# EasyEDA Pro project ProPrj_Avaota A1 八核 AIoT 开发板_2024-05-03.epro, board PCB1 (continued)
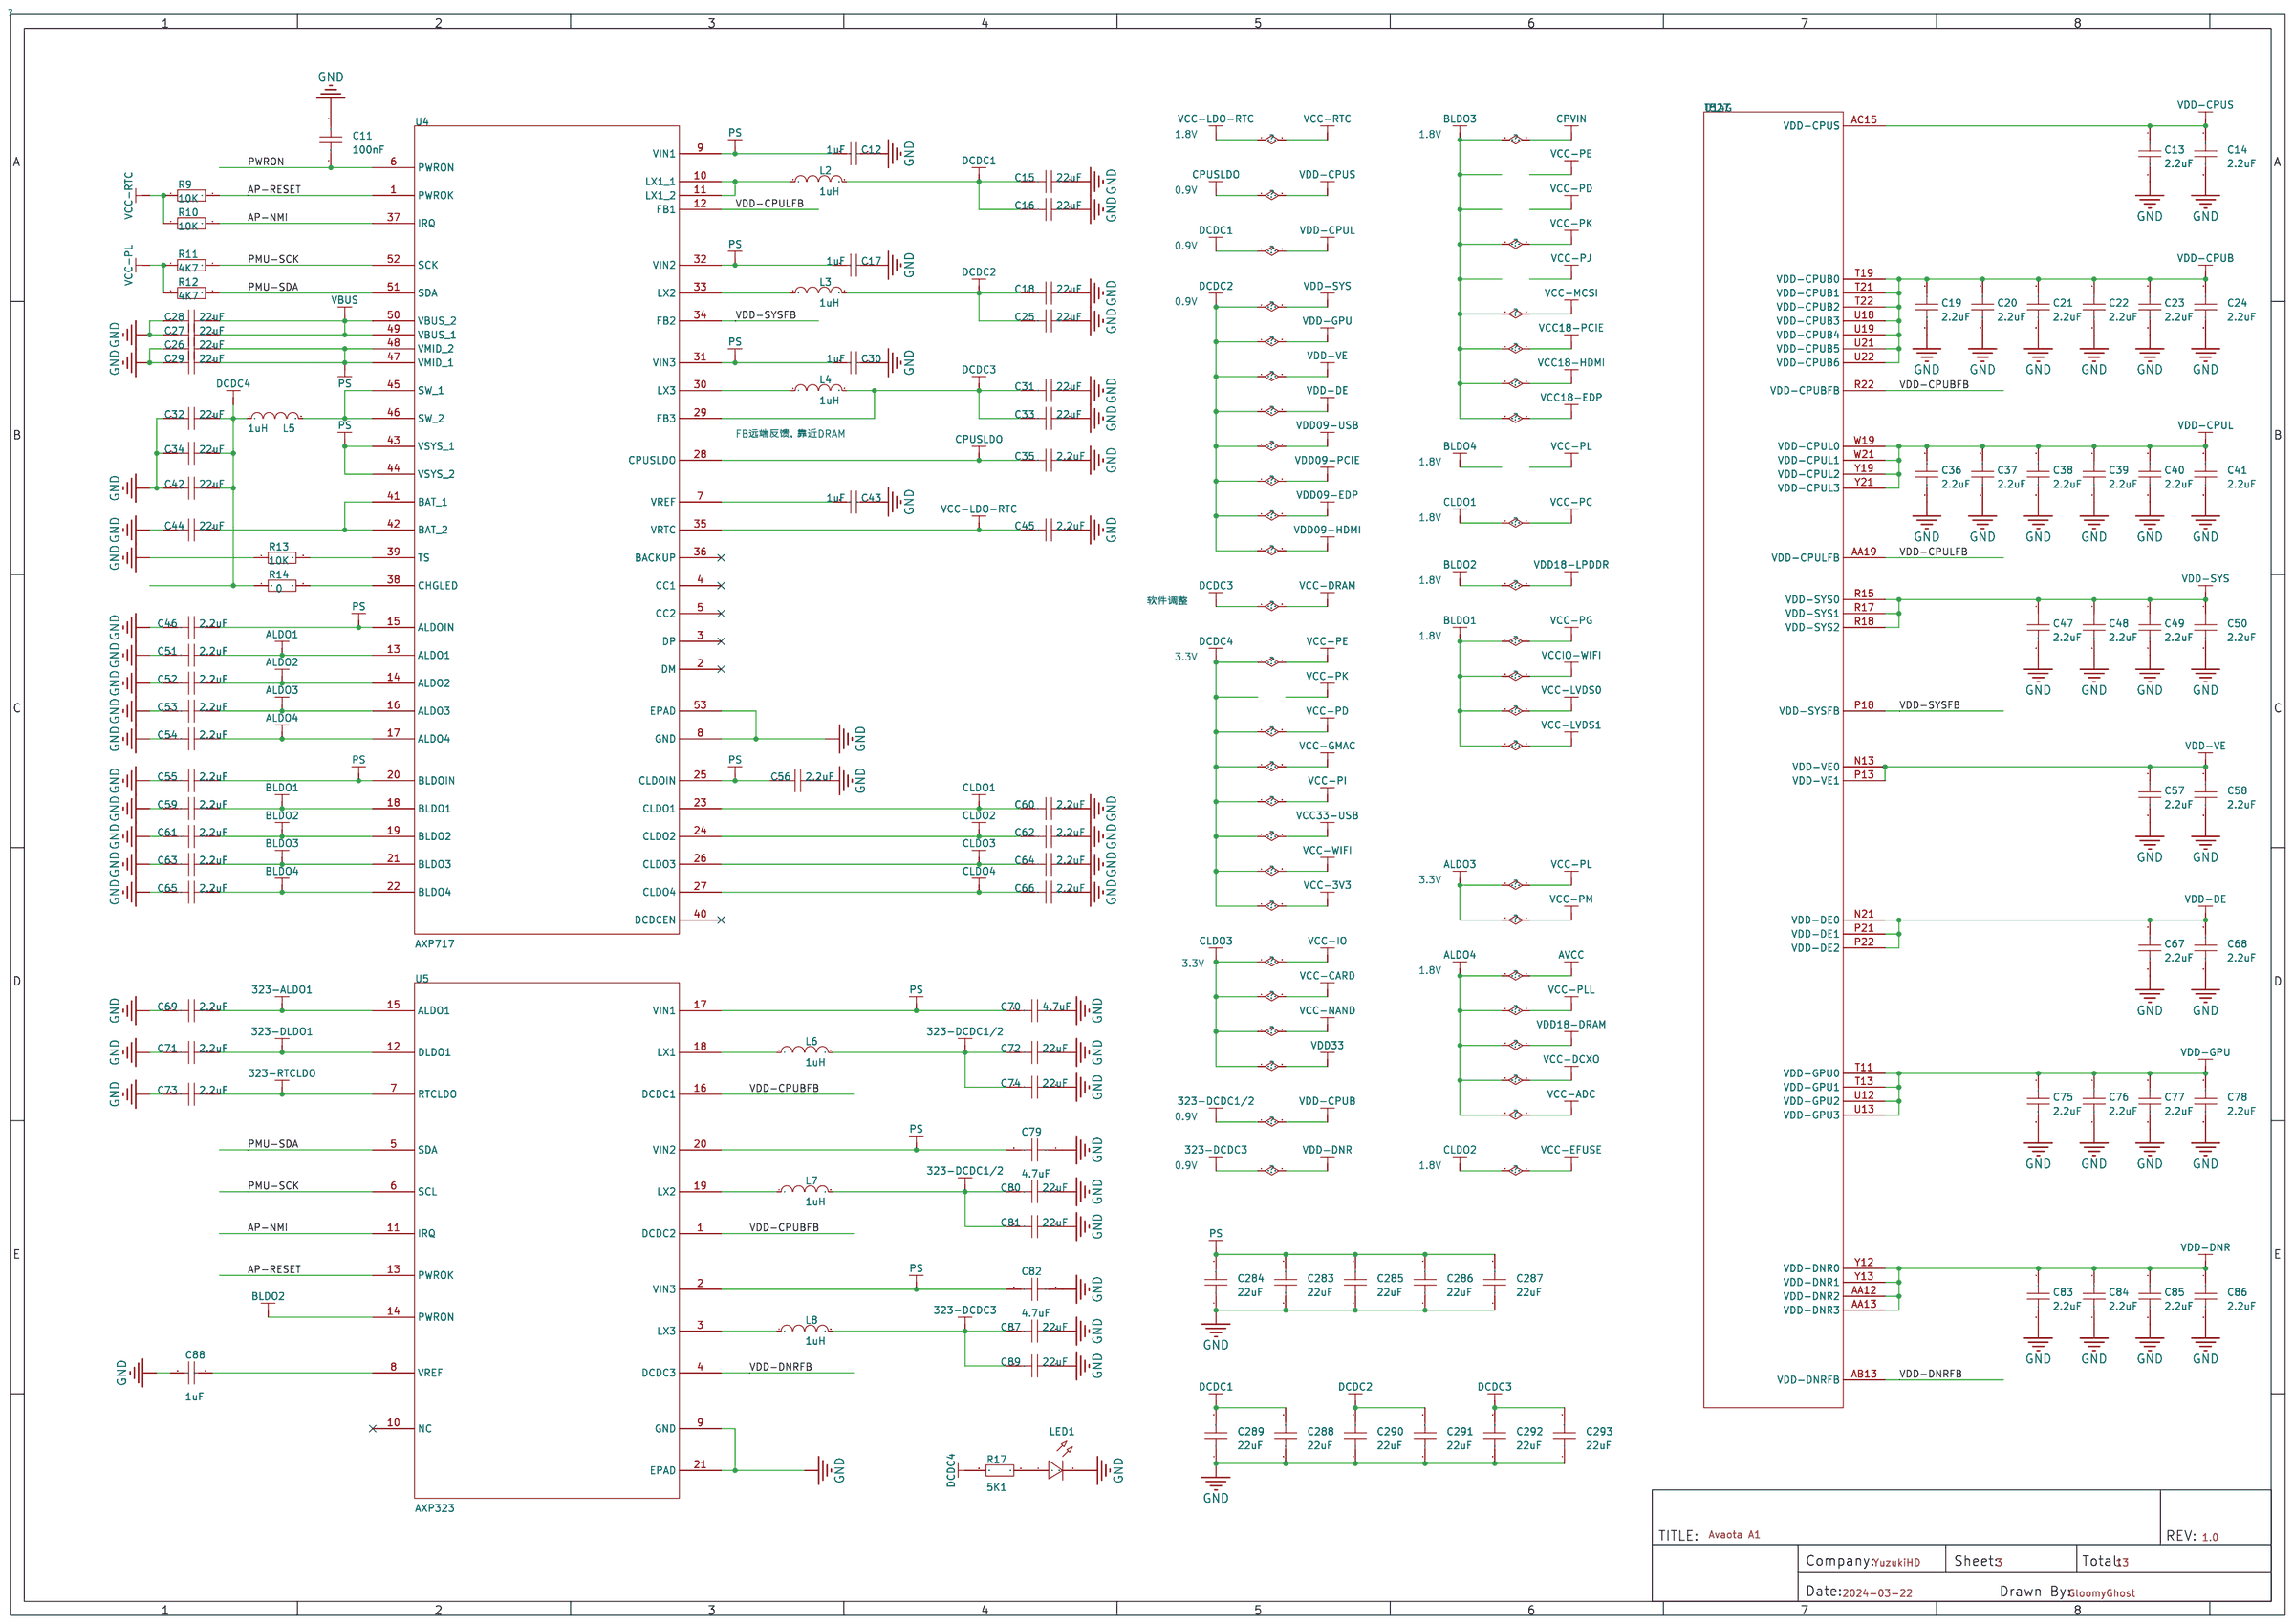
[diagram p0: POWER]
## Routing (per net, layer and track width the routed paths; a pad name or vN(x,y) marks a point on that pad's centre or on a via; arc(x,y) is an arc through that point) (continued)
  Bottom Layer w0.508: 96.44,25.28 96.44,23.84 96.29,23.69
  Bottom Layer w0.762: RJ2.P10 91.06,11.88 RJ2.SHIELD0 RJ2.SHIELD1 75.2,9.49 RJ1.SHIELD0 ; RJ1.SHIELD0 RJ1.SHIELD1 ; RJ1.SHIELD0 72.79,11.9 RJ1.P10
  vias: v1(15.85,43.49) v1(16.71,43.49) v1(16.71,42.61) v1(58.23,56.63) v1(70.18,45.3) v1(75.64,4.19) v1(76.33,1.14) v1(76.89,4.19) v1(85.47,54.43) v1(85.47,53.85) v1(85.83,57) v1(85.83,56.41) v2(6.6,65.96) v2(6.6,65.18) v2(6.66,64.47) v2(6.66,63.88) v2(6.76,66.5) v2(6.68,63.04) v2(6.68,62.26) v2(7.04,61.75) v2(7.24,66.68) v2(7.49,52.96) v2(7.49,52.25) v2(7.49,51.46) v2(7.49,50.7) v2(7.9,61.62) v2(8.13,66.75) v2(8.31,52.96) v2(8.31,52.25) v2(8.31,51.46) v2(8.31,50.7) v2(8.81,61.62) v2(8.94,66.8) v2(9.12,52.96) v2(9.12,52.25) v2(9.12,51.46) v2(9.47,38.53) v2(9.78,61.7) v2(9.93,66.5) v2(9.93,52.96) v2(9.93,52.25) v2(9.93,51.46) v2(10.16,65.58) v2(10.46,62.15) v2(10.67,66.27) v2(10.59,63.32) v2(10.77,65.51) v2(10.97,62.66) v2(11.13,63.6) v2(11.46,65.48) v2(11.51,63.02) v2(11.61,66.17) v2(11.61,64.77) v2(11.91,63.63) v2(12.12,65.51) v2(12.14,64.74) v2(12.17,63.02) v2(12.5,63.65) v2(12.85,65.43) v2(12.93,62.99) v2(13.16,64.77) v2(13.33,63.7) v2(13.51,65.46) v2(13.59,63.02) v2(13.94,64.74) v2(14,63.73) v2(14.27,65.46) v2(14.43,63.02) v2(14.55,64.77) v2(14.6,63.7) v2(20.96,59.26) v2(22.22,59.26) v2(28.7,18.81) v2(57.78,26.26) v2(62.2,20.54) v2(65.38,23.56) v2(65.38,22.85) v2(65.38,22.06) v2(65.38,21.3) v2(66.19,23.56) v2(66.19,22.85) v2(66.19,22.06) v2(66.19,21.3) v2(67.01,23.56) v2(67.01,22.85) v2(67.01,22.06) v2(67.01,21.3) v2(67.82,23.56) v2(67.82,22.85) v2(67.82,22.06) v2(67.82,21.3) v2(69.37,37.9) v2(69.8,37.11) v2(71.25,34.65) v2(72.87,34.21) v2(73.46,35.66) v2(73.63,33.12) v2(73.63,31.72) v2(75.08,36.35) v2(79.3,49.78) v2(80.75,20.38) v2(83.54,23.29) v2(83.54,22.58) v2(83.54,21.79) v2(83.54,21.03) v2(84.35,23.29) v2(84.35,22.58) v2(84.35,21.79) v2(84.35,21.03) v2(85.16,23.29) v2(85.16,22.58) v2(85.16,21.79) v2(85.16,21.03) v2(85.98,23.29) v2(85.98,22.58) v2(85.98,21.79) v2(85.98,21.03) v2(90.68,36.47) v3(51.74,47.73)
VBUS: length 326.8
  Top Layer w0.127: 41.76,23.62 41.48,23.34 R52.1 ; 41.76,23.62 39.73,23.62 v1(39.57,23.47) ; 41.76,23.62 42.27,23.62 42.54,23.34 R53.1
  Top Layer w0.152: C222.2 39.5,24.18
  Top Layer w0.203: D9.2 v1(39.57,22.25)
  Top Layer w0.254: LED5.4 2.3,8.19 1.7,8.79 1.7,10.22 LED4.4 2.42,11.14 1.68,11.89 1.68,13.15 LED3.4 2.34,14.09 1.85,14.58 v2(1.85,16.28) LED2.4
  Top Layer w0.508: D1.2 17.22,35.06 v2(17.22,36.07) v2(17.22,36.58) ; v1(96.72,66.88) v1(96.27,66.88) C280.2 94.27,66.88 U17.5
  内层4 w0.508: v2(97.61,22.25) 97.61,22.78 95.86,24.54 80.87,24.54 78.66,22.33 74.88,22.33 73.13,24.08 68.91,24.08 68.05,24.94 61.95,24.94 60.83,23.83 59.41,23.83 57.38,21.79 51.33,21.79 50.14,20.6 42.01,20.6 v2(38.49,17.08) v2(38.16,16.75)
  Inner5 w0.508: v1(96.72,66.88) v1(96.27,66.88) 95.81,66.42 95.81,62.92 96.29,62.43 96.29,55.91 95.05,54.66 95.05,51.16 95.71,50.5 95.71,48.46 97.61,46.56 v2(97.61,22.25) ; 3.81,19.1 3.81,18.24 v2(1.85,16.28) ; H1.4 H1.2 6.22,71.55 6.22,69.93
  Inner5 w1.27: 2.9,65.32 2.9,55.45 2.15,54.71 2.15,51.95 2.49,51.61 2.49,38.3 ; 2.9,65.32 6.22,68.65 6.22,69.93 ; 2.9,65.32 2.9,65.46 2.87,65.48 ; v4(10.77,43.56) 9.58,42.37 ; v4(10.77,43.56) v4(10.77,42.7) 10.77,42.67 10.79,42.65 8.43,40.28 ; v4(10.77,43.56) 10.74,43.59 v4(9.93,43.59) ; 9.58,42.37 9.58,43.23 v4(9.93,43.59) ; 9.58,42.37 9.58,41.96 ; 9.58,42.37 7.49,40.28 ; v2(7.39,37.44) 7.39,39.24 8.43,40.28 ; 10.24,43.15 10.24,43.28 v4(9.93,43.59) ; 5.89,40.28 9.19,43.59 v4(9.93,43.59) ; 5.89,40.28 7.49,40.28 ; 5.89,40.28 5.77,40.28 3.2,37.72 ; 8.43,40.28 7.49,40.28 ; 22.1,14.76 18.59,14.76 17.48,13.64 6.5,13.64 4.14,16 4.14,19.23 3.2,20.17 3.2,37.72 ; 3.2,37.72 2.69,38.21 ; 36.47,15.04 35.79,15.72 22.71,15.72 21.89,14.91
  Bottom Layer w0.203: v1(39.57,22.25) v1(39.57,23.47)
  Bottom Layer w0.254: FPC1.1 7.05,37.78 v2(7.39,37.44) ; v2(7.39,37.44) 7.23,37.28 FPC1.2 ; v2(7.39,37.44) C247.2
  Bottom Layer w0.508: v2(97.61,22.25) 97.61,23.64 U11.3 97.56,25.18 97.46,25.28 ; v2(38.49,17.08) 39.57,18.16 v1(39.57,22.25) ; USB2.10 26.01,9.96 26.01,7.71 USB2.1 ; v2(38.16,16.75) v2(36.65,15.24) 36.45,15.04 v2(36.24,14.83)
  Bottom Layer w0.762: 12.31,41.46 12.19,41.58 12.19,41.63 ; 12.31,41.46 15.85,37.92 16.61,37.92 17.22,37.31 v2(17.22,36.58) v2(17.22,36.07) ; 12.31,41.46 12.31,41.51 12.19,41.63 ; 12.19,41.63 12.19,42.49 11.13,43.56 v4(10.77,43.56) v4(10.77,42.7) 11.84,41.63 12.19,41.63
  Bottom Layer w1.27: USB2.1 25.53,5.3 28.93,1.91 36.6,1.91 38.15,3.45 38.15,13.34 C294.2
  vias: v1(4.12,50.29) v1(4.12,49.76) v1(4.12,49.23) v1(4.12,48.66) v1(5.13,50.37) v2(4.62,50.32) v2(35.89,15.52) v2(36.98,14.66) v4(9.09,43.6) v4(9.88,42.79)
VBUS-USB: length 13.7
  Top Layer w0.152: U17.1 91.97,68.11 R120.2
  Top Layer w0.508: U17.1 90.59,66.86 C281.2 C282.2 89.09,66.82 88.1,67.81 USB3.A4B9 88.1,69.28 87.71,69.67 86.33,69.67 85.98,70.03 84.89,70.03 84.61,69.75 83.52,69.75 83.2,69.43 USB3.B4A9
VCC-3V3-BLK: length 2.1
  Bottom Layer w0.254: C277.2 88.77,46.33 R126.2 88.72,47.76 88.72,47.76
VCC-LDO-RTC: length 72.5
  Top Layer w0.152: R10.1 7.85,47.32 7.49,46.96 6.4,46.96 v1(6.27,47.09) R9.1
  Top Layer w0.203: U14.AE13 57.44,50.18 v2(57.94,50.67) ; U4.35 7.86,55.15 7.52,55.5 5.77,55.5 5.36,55.91 C45.2
  内层2 w0.152: v2(6.4,50.24) 6.27,50.11 v1(6.27,47.09)
  Inner5 w0.381: v2(14.53,53.95) 14.22,53.95 13.59,54.58 12.55,54.58 12.42,54.71 6.55,54.71 v2(5.47,55.79)
  Bottom Layer w0.152: v2(5.47,55.79) 5.82,55.45 6.88,55.45 7.04,55.3 7.04,50.88 v2(6.4,50.24)
  Bottom Layer w0.203: v2(14.53,53.95) 16.08,55.5 47.29,55.5 51.55,51.24 57.37,51.24 v2(57.94,50.67)
VDD-CPUBFB: length 70.8
  Top Layer w0.203: U5.16 17.66,41.87 v1(17.65,41.86) ; v1(17.37,44.68) 17.31,44.68 U5.1
  内层2 w0.254: v1(17.37,44.68) 18.59,44.68 27.1,53.19 27.1,56.08 31.9,60.88 52.58,60.88 55.63,57.84 55.63,57.48 56.57,56.54 57.18,56.54 59.82,53.9 60.88,53.9 61.29,53.49 61.29,52.63 61.9,52.02 61.95,52.02 61.95,51.33 61.49,50.88 61.49,50.37 61.72,50.14 62.31,50.14 63.37,49.07 63.37,47.37 63.96,46.79 63.96,46.48 63.12,45.65 v2(62.44,45.65)
  Bottom Layer w0.254: v1(17.37,44.68) 17.81,44.68 18.26,44.22 18.26,43.49 17.65,42.88 v1(17.65,41.86)
VDD-CPULFB: length 62
  Top Layer w0.254: v1(10.69,48.29) 10.66,48.31 U4.12
  Inner5 w0.254: v2(59.44,47.14) 59.13,47.14 58.85,47.42 58.85,48.41 58.42,48.84 57.94,48.84 57.61,49.17 54.15,49.17 53.62,49.71 52.68,49.71 52.1,50.29 52.1,50.88 51.82,51.16 51.23,51.16 46.25,56.13 32.56,56.13 25.6,49.17 17.93,49.17 13.61,44.86 11.38,44.86 10.39,45.85 10.39,47.98 v1(10.69,48.29)
VDD-DNRFB: length 52.6
  Top Layer w0.203: v2(15.34,45.92) 15.47,45.92 15.65,45.75 15.65,45.01 15.85,44.8 U5.4
  VCC w0.254: v2(15.34,45.92) 15.8,46.38 22.4,46.38 31.88,55.85 45.85,55.85 52.48,49.23 58.02,49.23 v2(58.94,50.15)
VDD-SYSFB: length 65.8
  Top Layer w0.203: U4.34 8.26,54.37 v1(8.05,54.15)
  Top Layer w0.254: v2(62.94,48.16) 62.94,47.65
  内层4 w0.254: v2(62.94,48.16) 62.94,48.01 62.56,47.62 60.27,47.62 58.75,49.15 52.55,49.15 45.47,56.24 20.07,56.24 16.87,59.44 14.55,59.44 13.94,60.05 10.85,60.05 9.09,58.29 9.09,57.05 8.05,56.01 v1(8.05,54.15)
323-ALDO1: length 0.8
  Top Layer w0.203: C69.1 17.05,40.9 U5.15
323-DCDC1/2: length 10.9
  Top Layer w0.203: v2(61.44,46.66) U14.U21 ; v2(61.44,46.66) v2(60.93,46.66) 60.96,46.63 v2(60.96,46.15) ; v2(61.44,46.66) 61.95,46.66 ; U14.T21 61.95,46.15 61.95,46.66 ; 61.95,46.66 61.95,47.14 U14.T19 ; U14.U18 U14.U19 61.44,46.66
  Bottom Layer w0.254: v2(61.94,45.65) 61.95,45.64 C22.1 62.5,45.12 62.51,45.14 ; v2(61.94,45.65) 61.94,46.94 C24.1 C19.1 61.44,46.88 v2(61.44,46.66) ; v2(61.94,45.65) v2(61.44,45.65) ; 60.9,45.64 60.96,45.71 v2(60.96,46.15) 60.96,46.63 v2(60.93,46.66) v2(61.44,46.66) ; v2(61.44,45.65) C23.1 ; v2(61.44,45.65) v2(61.44,46.66)
  vias: v1(21.97,45.01) v1(21.97,44.36) v1(21.97,43.69) v1(21.97,43.05) v1(21.97,42.48) v1(21.97,41.76) v1(22.05,41.05) v1(22.57,41.05)
323-DCDC3: length 5.1
  Top Layer w0.254: v2(59.44,49.64) v2(59.44,50.15) U14.AA12 ; U14.Y12 v2(59.94,50.15) v2(59.94,49.64)
  Bottom Layer w0.254: C85.1 59.94,49.53 v2(59.94,50.15) ; C83.1 59.44,49.51 v2(59.44,49.64) v2(59.44,50.15) ; C83.1 59.77,49.46 v2(59.94,49.64) 60.12,49.46 C86.1 ; C83.1 C84.1
  vias: v1(18.21,48.49) v1(18.21,47.89) v1(18.73,47.89) v1(18.72,47.34)
323-DLDO1: length 0.8
  Top Layer w0.203: U5.12 15.85,40.91 C71.1
323-RTCLDO: length 1.1
  Top Layer w0.203: C73.1 14.1,43.61 14.3,43.41 14.84,43.41 U5.7
ADCIN0: length 4.1
  Bottom Layer w0.152: C106.2 60.67,55.42 R26.2 60.83,55.33 60.83,52.54
  Bottom Layer w0.178: v1(60.44,52.15) 60.83,52.54
ADCIN1: length 4.7
  Bottom Layer w0.178: C107.2 61.28,55.94 R27.2 61.28,55.21 61.14,55.07 61.14,52.27 60.51,51.65 v1(60.44,51.65)
ALDO1: length 2.5
  Top Layer w0.203: C51.1 12.75,47.83 12.32,48.26 11.38,48.26 11.07,48.57 11.07,48.9 U4.13
ALDO2: length 2
  Top Layer w0.203: U4.14 11.58,49.07 11.96,48.69 12.35,48.69 12.63,48.41 C52.1
ALDO3: length 80
  Top Layer w0.152: v1(5.18,47.12) R11.1 R12.1
  Top Layer w0.203: U4.16 12.03,50.23 12.73,49.53 v2(12.92,49.53)
  Top Layer w0.254: v2(56.44,52.15) U14.AE11
  Top Layer w0.457: v2(49.53,61.54) 49.53,61.57 v2(49.15,61.95) 49.05,62.05 v2(42.11,62.05) v2(41.5,62.05)
  VCC w0.152: v1(5.18,47.12) 5.53,47.47 5.99,47.47 6.58,48.06 6.58,49.15 6.43,49.3 6.43,49.71 6.81,50.09 6.81,54 7.39,54.58 11.13,54.58 11.96,53.75 11.96,52.86 12.47,52.35 12.47,49.97 v2(12.92,49.53)
  Inner5 w0.457: v2(12.92,49.53) 12.57,49.53 12.14,49.96 12.14,51.21 12.73,51.79 13.37,51.79 14.79,53.21 18.62,53.21 20.6,55.19 22.92,55.19 29.78,62.05 v2(41.5,62.05)
  Bottom Layer w0.254: v2(49.53,61.54) 49.5,61.52 49.5,60.17 50.6,59.08 50.6,57.66 52.15,56.11 52.15,55.47 53.62,54 53.92,54 54.15,54.23 54.79,54.23 54.91,54.1 55.19,54.1 55.45,53.85 55.45,53.49 56.44,52.5 v2(56.44,52.15)
ALDO4: length 103.6
  Top Layer w0.102: 60.35,59.37 R31.2 v1(59.79,59.82) ; 60.35,59.37 60.91,59.37 R20.2 ; 60.35,59.37 R19.2 ; v1(56.97,59.79) R32.2 ; v1(58.67,59.84) R30.2
  Top Layer w0.203: U14.AB9 58.94,52.34 59.26,52.65 59.95,52.65 v1(60.44,53.15) ; U14.AD15 U14.AG15 ; v2(12.92,50.09) 12.84,50.17 12.6,50.17 12.14,50.63 U4.17
  Top Layer w0.254: v2(56.44,48.62) 56.44,49.14 U14.AG15
  内层2 w0.254: v1(58.67,59.84) 58.67,59.74 58.22,59.28 57.25,59.28 56.97,59.56 v1(56.97,59.79)
  VCC w0.381: v2(56.44,48.62) 56.74,48.62 57.2,48.16 57.74,48.16 58.93,49.35 ; 58.93,49.35 58.93,45.36 58.72,45.16 58.19,45.16 57.94,44.91 v1(57.94,44.15) ; 58.93,49.35 59.21,49.07 60.35,49.07 60.93,49.66 v2(60.93,51.43) 60.93,52.65 v1(60.44,53.15) 59.68,53.15 58.85,53.98 58.85,57 58.39,57.46 58.39,58.47 58.67,58.75 v1(58.67,59.84) 58.67,60.05 58.98,60.35 59.46,60.35 59.79,60.02 v1(59.79,59.82)
  Inner5 w0.457: 18.85,52.53 20.8,54.48 23.3,54.48 30.11,61.29 45.82,61.29 48.77,58.34 54.53,58.34 56.87,56.01 58.7,56.01 60.44,54.26 v1(60.44,53.15) ; 18.77,52.48 15.09,52.48 13.87,51.26 13.87,50.57 13.39,50.09 12.92,50.09 12.92,50.09
  Bottom Layer w0.127: R24.2 60.19,51.26 60.76,51.26 v2(60.93,51.43)
  Bottom Layer w0.152: 59.72,53.92 60.44,53.2 v1(60.44,53.15)
  Bottom Layer w0.203: v1(60.44,53.15) 60.25,53.34 59.72,53.34
  Bottom Layer w0.254: C90.2 C93.2 56.24,48.91 56.44,48.71 v2(56.44,48.62) ; 52.58,44.37 52.72,44.22 56.7,44.22 57.21,43.71 57.63,43.71 57.94,44.02 ; 52.58,44.37 52.55,44.34 ; 52.58,44.37 51.62,44.37 51.61,44.36 ; 57.94,44.02 v1(57.94,44.15) ; 57.94,44.02 57.94,43.67 C133.2
ALDO-OUT: length 0.4
  Bottom Layer w0.178: v1(57.44,53.15) 57.43,53.14 57.43,53.14 C103.2
AP-NMI: length 84.4
  Top Layer w0.076: 53.04,51.4 53.7,51.4
  Top Layer w0.102: v1(52.81,51.63) 53.04,51.4 ; U14.AM10 53.94,51.65 53.7,51.4
  Top Layer w0.127: U5.11 15.3,41.76 v1(13.41,41.76)
  Top Layer w0.152: U4.37 7.06,54.37 7.23,54.2 7.44,54.2 v2(7.57,54.08) ; v2(7.39,48.01) 7.79,48.01 R10.2
  VCC w0.102: v2(7.57,54.08) 7.07,53.57 7.07,49.96 v2(7.44,49.58)
  VCC w0.152: v2(7.44,49.58) 7.39,49.53 v2(7.39,48.01)
  Bottom Layer w0.102: v1(13.41,41.76) 13.28,41.88 13.28,43.41 12.27,44.42 6.66,44.42 5.28,45.8 5.28,46.43 4.8,46.91 4.8,47.4 5.26,47.85 5.26,48.03 4.52,48.77 4.52,49.53 4.98,49.99 5.77,49.99 6.53,49.23 7.09,49.23 v2(7.44,49.58) 7.77,49.91 9.09,49.91 9.6,50.42 11.71,50.42 11.91,50.62 11.91,55.17 13.59,56.85 35.69,56.85 36.37,57.53 42.27,57.53 43.84,55.96 47.65,55.96 51.99,51.61 52.79,51.61 v1(52.81,51.63)
  Bottom Layer w0.254: v1(52.81,51.63) 53.28,51.63 C94.2
AP-RESET: length 85.4
  Top Layer w0.102: U4.1 6.26,49.11 6.76,49.61 v2(6.86,49.61)
  Top Layer w0.127: v1(16.26,41.02) 16.25,41.03 U5.13
  Top Layer w0.152: v2(22.78,38.89) 23.36,38.89 R21.2 ; U4.1 6.27,48.9 R9.2 6.77,47.97 C95.2
  Top Layer w0.254: U14.AJ11 55.45,51.15 v1(55.45,51.64)
  VCC w0.127: v2(14.6,44.3) 14.5,44.2 8.84,44.2 6.83,46.2 6.83,49.58 v2(6.86,49.61)
  VCC w0.152: v1(16.26,41.02) 16.26,40.46 17.83,38.89 v2(22.78,38.89)
  Bottom Layer w0.102: 55.4,51.66 55.14,51.66 54.66,52.15 52.88,52.15 52.7,51.97 52.65,51.97 52.55,51.87 52.15,51.87 47.78,56.24 43.99,56.24 42.37,57.86 36.25,57.86 35.51,57.12 13.41,57.12 11.68,55.4 11.68,50.83 11.48,50.62 9.47,50.62 9.04,50.19 7.44,50.19 v2(6.86,49.61)
  Bottom Layer w0.127: v1(16.26,41.02) 14.6,42.67 v2(14.6,44.3)
AP-WAKE-BT: length 52.7
  Top Layer w0.102: v1(61.95,54.65) U14.U4
  Top Layer w0.203: R69.2 15.61,60.5 15.72,60.6
  Top Layer w0.254: v1(17.02,60.53) U9.6
  Inner5 w0.102: v1(17.02,60.53) 17.6,59.94 19.3,59.94 22.07,62.71 45.14,62.71 48.97,58.88 55.07,58.88 56.34,57.61 57.84,57.61 60.8,54.65 v1(61.95,54.65)
AXP717-CC1: length 3.9
  Top Layer w0.102: D24.2 86.66,66.43 86.66,65.35 86.98,65.04 R130.2
  Top Layer w0.127: USB3.A5 86.92,68.53 86.92,67.59 87.07,67.44 87.07,66.86
AXP717-CC2: length 2.8
  Top Layer w0.102: R129.2 83.11,66.92 D31.2
  Top Layer w0.127: USB3.B5 83.9,67.6 D31.2 83.13,66.84
BLDO1: length 99.3
  Top Layer w0.152: v1(62.46,52.68) 62.46,52.53 62.08,52.15 U14.T9 ; U14.N9 v1(63.44,52.58)
  Top Layer w0.203: U4.18 12.24,51.03 12.62,50.65 v2(12.92,50.65)
  Top Layer w0.254: 14.12,60.53 R69.1 ; 14.12,60.53 14.12,59.91 R70.1 ; 14.12,60.53 v2(14.12,61.19) 14.12,61.71 C180.2 C179.2
  Top Layer w0.508: v2(24.71,57.99) 26.04,56.66 U9.22
  VCC w0.381: 53.75,53.59 54.2,53.14 56.44,53.14 v2(56.92,53.62)
  VCC w0.508: 53.75,53.7 47.29,60.15 30.4,60.15 v2(28.68,58.42) 24.94,54.69 14.49,54.69 13.99,54.18 13.99,51.25 13.39,50.65 v2(12.92,50.65)
  Inner5 w0.254: v2(63.42,44.65) 63.55,44.53 64.08,44.53 64.44,44.88 64.44,47.04 64.9,47.5 64.9,49.81 64.57,50.14 64.21,50.14 62.99,51.36 62.66,51.36 61.87,52.15 ; 61.87,52.15 61.42,52.15 60.91,52.65 58.22,52.65 57.91,52.96 57.91,53.31 57.51,53.72 57.02,53.72 v2(56.92,53.62) ; 61.87,52.15 62.07,52.15 ; v1(62.46,52.68) 62.46,52.54 62.07,52.15 ; 62.07,52.15 63.12,52.15 63.44,52.47 v1(63.44,52.58)
  Bottom Layer w0.254: v1(63.44,52.58) 63.45,52.58 C165.2 ; C172.2 56.44,53.95 56.77,53.62 v2(56.92,53.62) ; v2(63.42,44.65) 63.32,44.55 C166.2 C171.2
  Bottom Layer w0.508: v2(14.12,61.19) 14.6,61.19 17.81,57.99 v2(24.71,57.99) 25.15,58.42 v2(28.68,58.42)
BLDO2: length 52
  Top Layer w0.102: 35.81,50.05 v3(35.46,49.7)
  Top Layer w0.127: U5.14 16.65,40.66 v1(16.64,40.64)
  Top Layer w0.203: U4.19 12.3,51.43 12.5,51.23 12.89,51.23 v2(12.92,51.21)
  Top Layer w0.254: 32.23,51.71 32.23,51.09 32.37,51.09 33.07,50.39 v3(33.1,50.39) 33.41,50.7 ; 33.41,43.55 v3(32.87,43.55) 32.7,43.71 32.23,43.71 ; v3(39.38,43.77) 39.4,43.77 39.81,44.18 39.81,44.2 ; 35.81,44.2 36.04,43.97 36.22,43.97 36.23,43.96 v3(36.23,43.96) ; v3(41.81,43.21) 42.15,43.55 42.21,43.55 ; 39.81,50.05 39.54,50.32 v3(39.39,50.32)
  Top Layer w0.305: v3(41.83,50.36) 41.84,50.37 41.87,50.37 42.21,50.7
  内层4 w0.508: v3(33.1,50.39) 32.48,50.39 31.57,49.48 17.83,49.48 15.75,51.56 v2(15.06,51.56) 13.27,51.56 v2(12.92,51.21)
  Bottom Layer w0.152: v2(15.06,51.56) 14.48,50.98 14.48,45.36 15.06,44.78 15.06,42.8 16.64,41.22 v1(16.64,40.64)
  Bottom Layer w0.203: v3(39.38,43.77) 39.8,44.19 39.8,44.93 41.12,44.93 41.81,44.25 41.81,43.87
  Bottom Layer w0.254: 35.99,44.4 35.99,44.2 v3(36.23,43.96) ; v3(39.38,43.77) 39.3,43.77 38.78,43.26 ; v3(32.87,43.55) 32.83,43.55 ; 41.81,43.87 v3(41.81,43.21) ; v3(35.46,49.7) 35.45,49.7 35.02,49.28 34.39,49.28 34.16,49.51 34.16,49.96 33.78,50.34 33.14,50.34 v3(33.1,50.39)
BLDO3: length 84.1
  Top Layer w0.152: v1(55.93,53.95) 55.64,53.95 U14.AJ5
  Top Layer w0.203: U4.21 12.48,52.23 12.57,52.32 v2(12.92,52.32)
  Top Layer w0.254: v2(63.96,51.13) 63.96,51.63 U14.M10 ; 64.45,49.66 64.96,49.66 65.46,49.16 U14.J15 ; 64.45,49.66 U14.K13 ; 64.45,49.66 v2(64.44,49.66) ; U14.M21 63.94,46.22 v2(63.53,46.63) ; U14.L22 63.96,45.16 v2(63.96,45.09)
  内层2 w0.254: v2(70.36,52.73) 70,52.73 68.94,51.66 65.63,51.66 65.1,51.13 v2(63.96,51.13)
  VCC w0.381: v1(55.93,53.95) 55.75,54.13 54.1,54.13 47.4,60.83 30.1,60.83 24.56,55.3 14.25,55.3 13.41,54.46 13.41,52.82 v2(12.92,52.32)
  Bottom Layer w0.127: C187.2 64.36,47.55
  Bottom Layer w0.254: C201.2 64.01,45.03 v2(63.96,45.09) ; v1(55.93,53.95) 55.62,54.26 C202.2 ; R127.1 R128.1 70.28,52.81 v2(70.36,52.73)
  Bottom Layer w0.381: 63.96,50.14 C208.2 61.11,50.14 60.6,50.65 59,50.65 57.99,51.66 57.18,51.66 56.95,51.89 56.95,52.68 55.93,53.7 v1(55.93,53.95)
  Bottom Layer w0.457: 64.36,47.55 65,48.18 65,49.38 64.72,49.66 v2(64.44,49.66) 63.96,50.14 v2(63.96,51.13) ; v2(63.96,45.09) 63.83,45.21 C185.2 C186.2 63.83,46.33 v2(63.53,46.63) 63.63,46.63 64.52,47.52
BLDO4: length 1.4
  Top Layer w0.203: C65.1 12.55,52.86 12.32,52.63 U4.22
BOOT-SEL-ADC: length 4.3
  Top Layer w0.076: 60.42,56.18 60.07,56.44 59.83,57.33
  Top Layer w0.102: 59.83,57.33 59.83,58.3 59.59,58.55 58.98,58.55 58.67,58.85 ; 58.67,58.85 58.64,58.89 R33.2 ; 58.67,58.85 R30.1
BT-RESETN: length 45.6
  Top Layer w0.076: 60.93,57.78 60.91,57.23 60.96,56.79 61.18,56.38 61.19,56.38 61.19,55.39 61.44,55.14
  Top Layer w0.102: 26.06,66.45 v2(26.06,65.19) ; 60.93,57.76 60.93,58.11 61.49,58.67 61.49,59.72 60.99,60.22 56.64,60.22 54.86,58.45 36.14,58.45 v1(35.94,58.24)
  Bottom Layer w0.102: v1(35.94,58.24) 35.53,58.65 35.41,58.65 28.86,65.19 v2(26.06,65.19)
BT-WAKE-AP: length 54.8
  Top Layer w0.102: U14.U5 v1(61.95,54.15)
  Top Layer w0.203: R70.2 15.56,59.87 15.72,59.7
  Top Layer w0.254: 15.7,59.63 16.24,59.63 16.54,59.92 17.22,59.92 17.5,60.2 v1(17.5,60.71)
  Inner5 w0.102: v1(17.5,60.71) 17.5,60.5 17.81,60.2 19.15,60.2 22.02,63.07 45.19,63.07 49.07,59.18 55.14,59.18 56.44,57.89 57.96,57.89 60.86,54.99 62.1,54.99 62.31,54.79 62.31,54.5 v1(61.95,54.15)
CAN-RX0: length 116.6
  Top Layer w0.152: v1(55.42,48.59) 55.42,48.16 U14.AJ17
  内层2 w0.102: v2(45.39,57.76) 45.77,57.38 46,57.38 46.96,56.41 49.86,56.41 51.84,54.43 51.84,51.37 54.14,49.07 55.18,49.07 55.42,48.83 v1(55.42,48.59)
  内层4 w0.102: v2(44.17,64.85) 45.42,66.09 52.43,66.09 57.56,60.96 60.91,60.96 62.28,59.59 86.11,59.59 88.72,56.97 88.72,53.72 87.25,52.25 87.25,33.07 94.49,25.83 95.73,25.83 98.58,22.99 v2(98.58,21.51)
  Bottom Layer w0.102: v2(45.39,57.76) 45.57,57.94 45.57,58.95 44.4,60.12 44.4,63.91 44.17,64.14 v2(44.17,64.85) ; U11.4 98.83,21.77 v2(98.58,21.51)
CAN-TX0: length 108.9
  Top Layer w0.152: v1(55.93,48.59) 55.93,48.16 U14.AH17
  内层2 w0.102: v1(55.93,48.59) 55.93,48.72 55.34,49.31 54.25,49.31 52.1,51.46 52.1,54.61 50.04,56.67 47.1,56.67 45.98,57.79 v2(45.97,57.79)
  内层4 w0.102: v2(94.84,25.4) 94.46,25.4 86.89,32.97 86.89,52.35 88.42,53.87 88.42,56.87 85.95,59.33 62.13,59.33 60.78,60.68 57.35,60.68 52.25,65.79 45.67,65.79 v2(44.7,64.82)
  Bottom Layer w0.102: v2(45.97,57.79) 45.97,59 44.7,60.27 v2(44.7,64.82) ; v2(94.84,25.4) 95.02,25.22 U11.1
CLDO1: length 79
  Top Layer w0.127: U8.N4 U8.P3 35.8,34.52 v1(35.59,34.52) ; U8.N4 U8.M4 ; U8.N4 U8.P5
  Top Layer w0.203: U4.23 12.24,53.03 12.6,53.39 v1(12.88,53.39)
  Top Layer w0.254: v1(41.22,33.3) 41.58,33.3 U8.C6
  Bottom Layer w0.508: v1(12.88,53.39) 13.79,52.48 13.79,42.32 20.62,35.48 35.03,35.48 35.59,34.93 v1(35.59,34.52) 35.59,32.39 36.3,31.67 41.18,31.67 ; 41.18,31.67 41.22,31.72 v1(41.22,33.3) ; 41.18,31.67 42.22,31.67 44.98,34.44 57.07,34.44 60.55,37.92 60.55,39.95 61.44,40.84 v1(61.44,43.64)
CLDO2: length 117.3
  Top Layer w0.203: U4.24 12.1,53.43 12.62,53.95 v2(12.92,53.95)
  Top Layer w0.254: U14.R26 62.03,43.23 v2(62.03,41.91)
  VCC w0.254: v2(12.92,53.95) 12.92,54.29 11.57,55.64 7.68,55.64 5.96,53.91 5.96,52.72 3.7,50.46 3.7,23.83 7.44,20.09 21.16,20.09 21.62,20.55 25.78,20.55 31.75,26.52 34.39,26.52 37.39,29.52 37.39,32.66 38.59,33.87 57.36,33.87 62.03,38.53 v2(62.03,41.91)
  Bottom Layer w0.254: v2(62.03,41.91) 62.48,42.37 62.48,43.03 C91.2
CLDO3: length 330.1
  Top Layer w0.127: R47.1 34.66,18.99 30.84,22.81 v2(29.13,22.81)
  Top Layer w0.203: 11.58,54.23 11.84,54.23 12.67,55.07 v2(12.92,55.07)
  Top Layer w0.254: 40.58,33.3 U8.J10 U8.K9 ; 40.58,33.3 U8.E6 ; 40.58,33.3 40.58,33.48 U8.F5 39.6,33.32 v2(39.6,33.17)
  VCC w0.254: v2(56.73,65.81) 57.8,66.88 62.56,66.88 63.7,68.02 67.13,68.02 68.71,69.6 76.2,69.6 78.54,71.93 91.69,71.93 95.17,68.45 97.05,68.45 97.54,67.97 97.54,64.95 97.16,64.57 97.16,52.69 v1(96.11,51.65)
  VCC w0.381: v2(12.92,55.07) 13.23,55.07 14,55.83 24.23,55.83 29.87,61.47 47.52,61.47 52.12,56.87 53.34,56.87 54.18,56.03 56.93,56.03 57.4,55.56 57.4,54.15 57.94,53.62 57.94,52.65 U14.AC9
  VCC w0.508: 3.1,50.98 5.36,53.24 5.36,54.48 7.05,56.18 11.8,56.18 v2(12.92,55.07) ; v1(96.11,51.65) 95.68,51.22 95.68,44.76 90.2,39.27 90.2,38.18 91.54,36.83 91.54,29.57 90.55,28.58 v2(83.19,28.58) 82.7,28.58 v2(82.68,28.55)
  VCC w0.635: v2(60.53,25.91) v2(60.07,25.91) 58.62,27.36 39.57,27.36 39.6,27.38 v2(39.6,33.17)
  VCC w0.762: 39.57,27.36 37.95,25.73 32.06,25.73 v2(29.13,22.81) 25.81,19.48 6.78,19.48 2.97,23.29 2.97,50.85 3.1,50.98
  Inner5 w0.508: v2(60.07,25.91) v2(60.53,25.91) 60.93,25.91 61.72,25.12 70.97,25.12 74.42,28.58 v2(83.19,28.58)
  Bottom Layer w0.152: C235.2 C229.2 40,32.77 v2(39.6,33.17) ; C234.1 C228.1 v2(95.72,46.76)
  Bottom Layer w0.254: SIM1.4 98.56,58.81 96.88,57.12 96.88,56.01 96.11,55.25 v1(96.11,51.65) D20.1 ; C102.2 v2(58.44,52.15) ; C230.2 39.4,32.97 v2(39.6,33.17) ; 57.38,66.27 57.19,66.27 v2(56.73,65.81) R75.2 ; 57.38,66.27 57.96,66.85 63.02,66.85 64.57,68.4 65.33,68.4 65.57,68.16 R73.2 65.57,67.4 66.78,66.19 R74.2 ; 57.38,66.27 57.28,66.17 ; 57.38,66.27 57.49,66.27
